# Altium schematic sheet GenPulseBox.SchDoc (part 1 of 2)
size 839 x 594 mm; DecimalNumber: Э-905 Э3; MainDevice: Генератор НЧ импульсов; Name: Генератор НЧ импульсов; PageSetup: Record=PageOptions|CenterHorizontal=True|CenterVertical=True|PrintScale=0.94|XCorrection=1.00|YCorrection=1.00|PrintKind=1|BorderSize=5000000|LeftOffset=0|BottomOffset=0|Orientation=1|PaperLength=1000|PaperWidth=1000|Scale=100|PaperSource=7|PrintQuality=-4|MediaType=1|DitherType=10|PaperKind=A4|PrintScaleMode=1; ApprovedBy: Кайбалдиев; CheckedBy: Савельев; DrawnBy: Соловьев; Engineer: Т.контр.; DocumentNumber: Э-905 Э3; SheetTotal: 1; Title1str: Генератор НЧ импульсов; DocumentType1str: Схема электрическая; DocumentType2str: принципиальная; ImagePath: Э-905
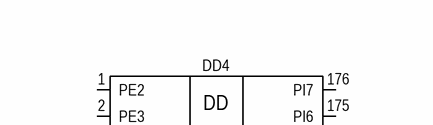
[diagram p0: GenPulseBox.SchDoc, top left]
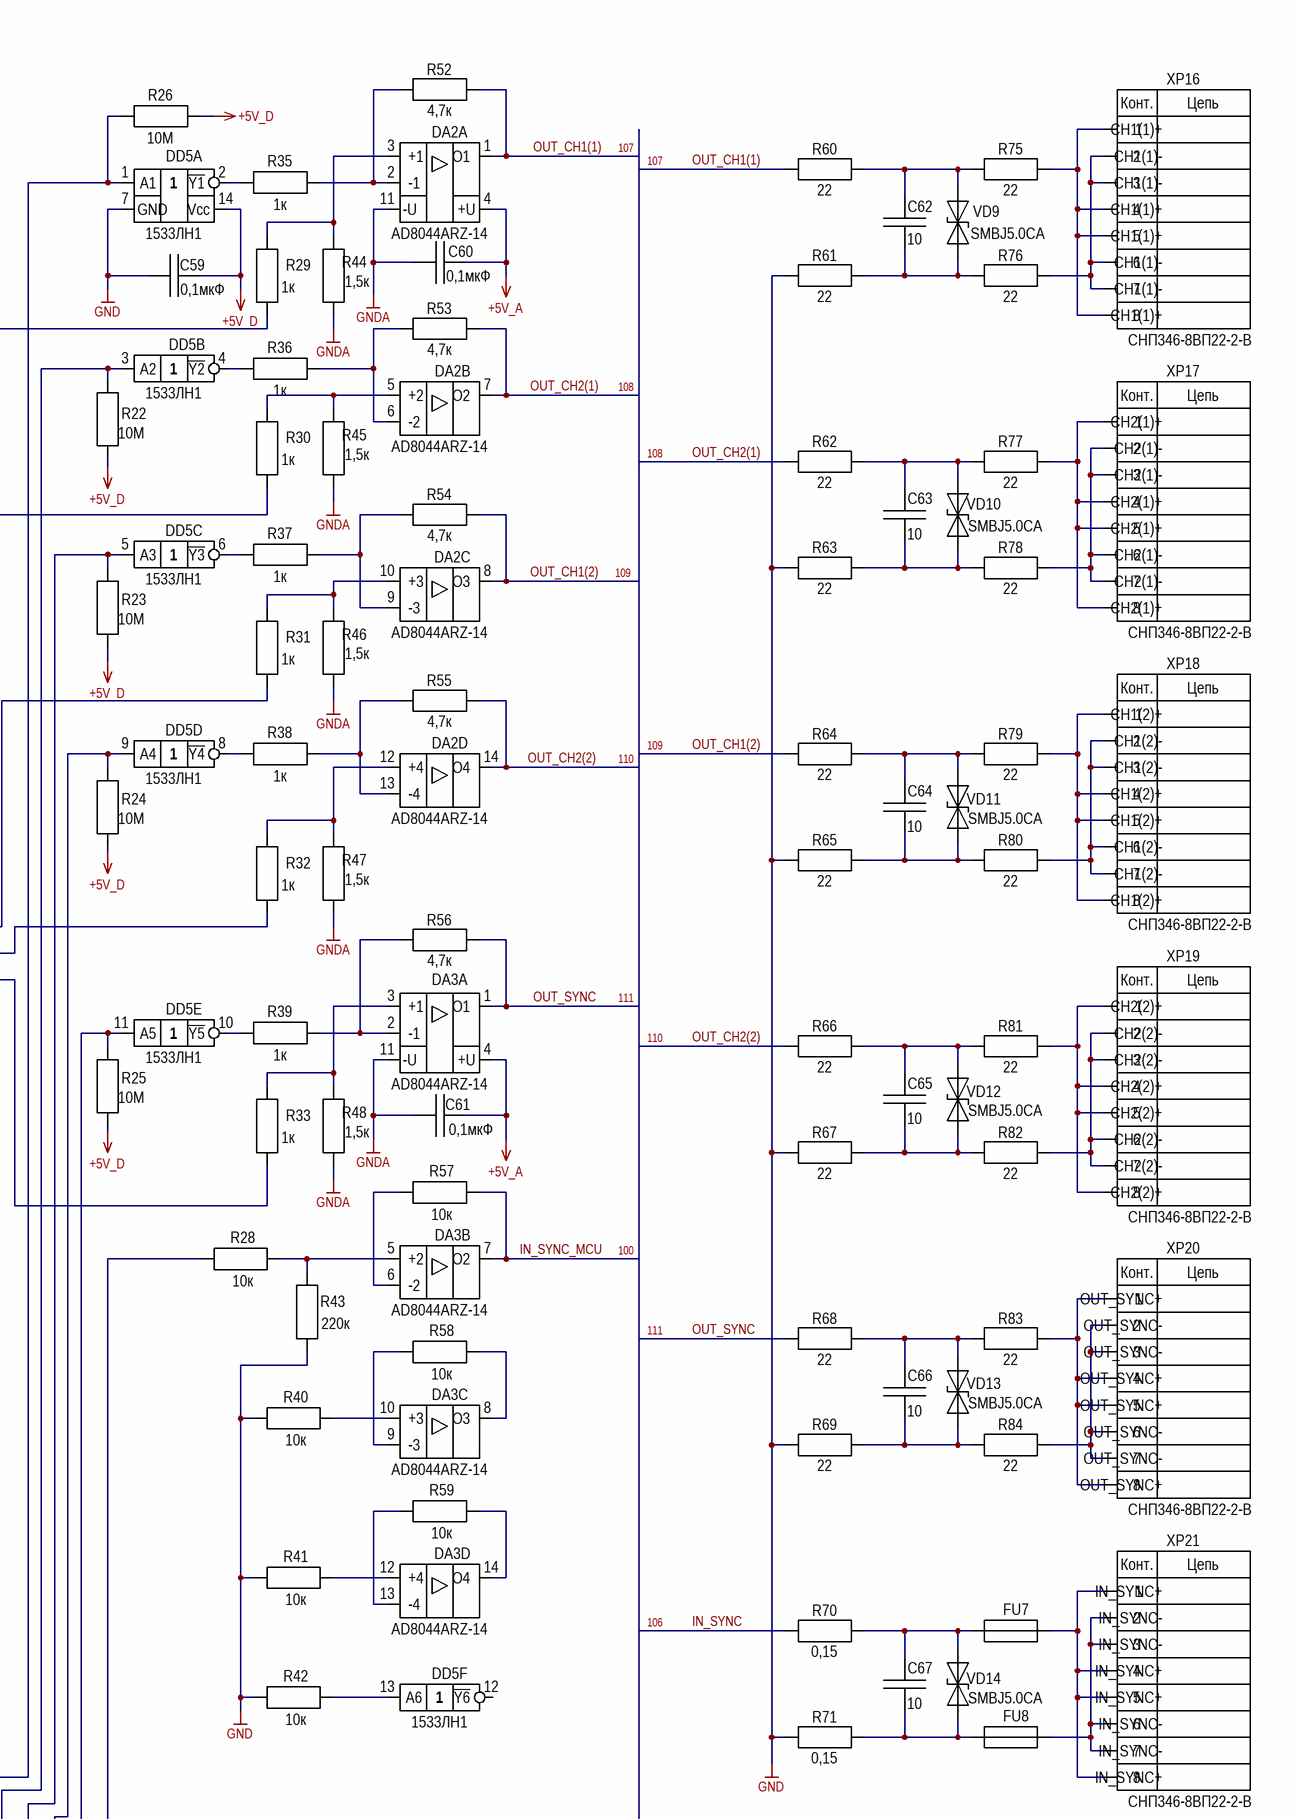
[diagram p1: GenPulseBox.SchDoc, top right]
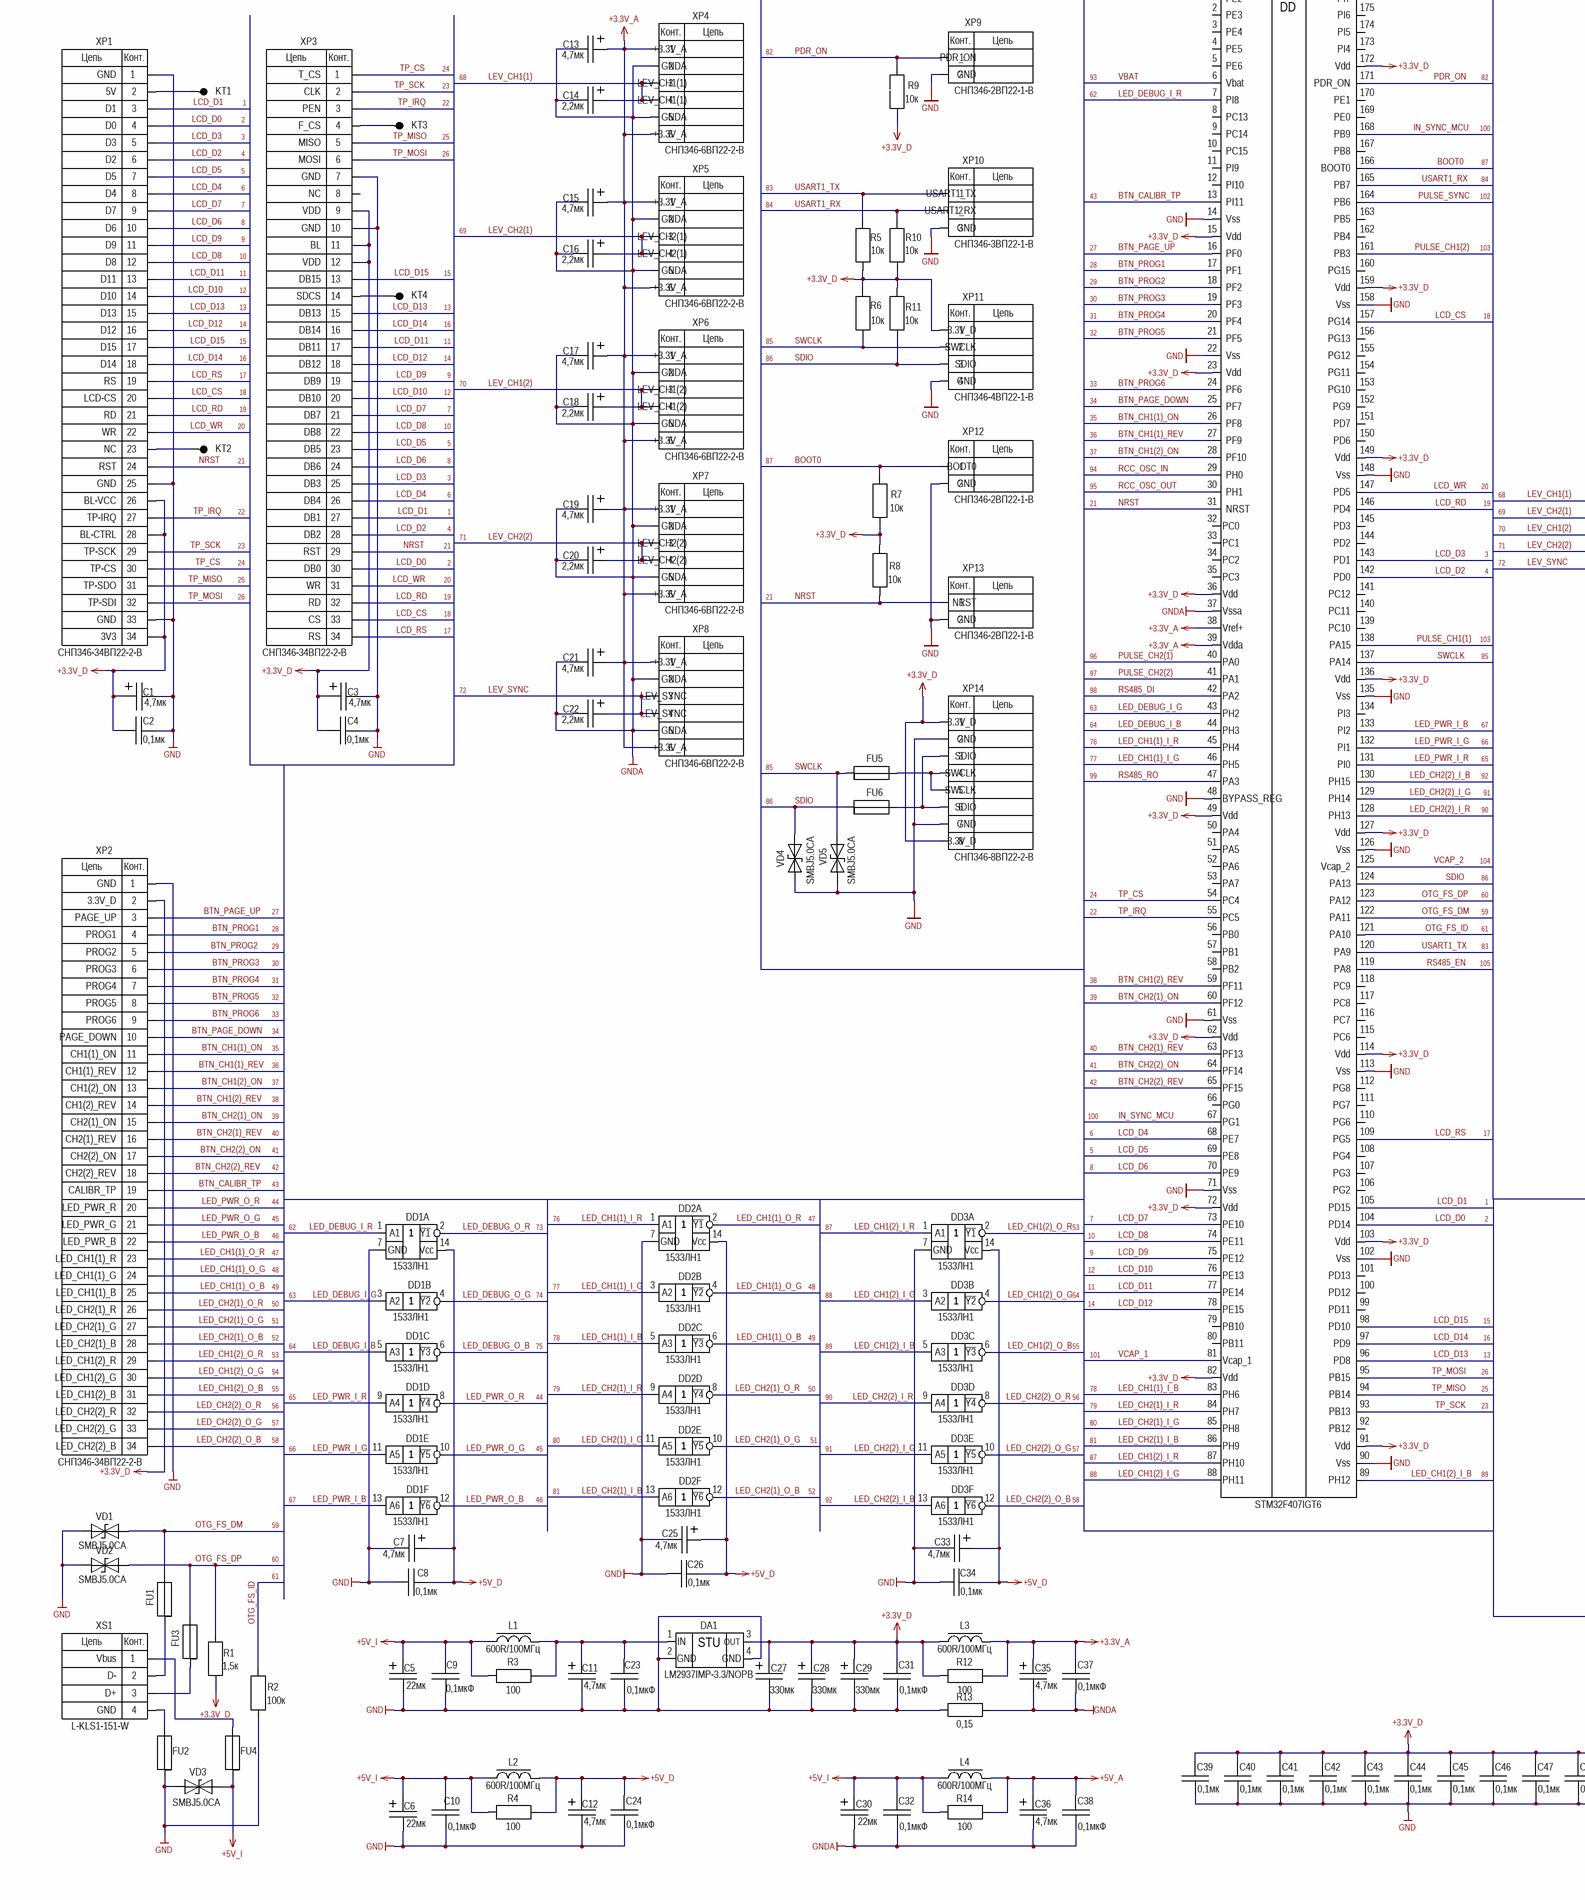
[diagram p2: GenPulseBox.SchDoc, bottom left]
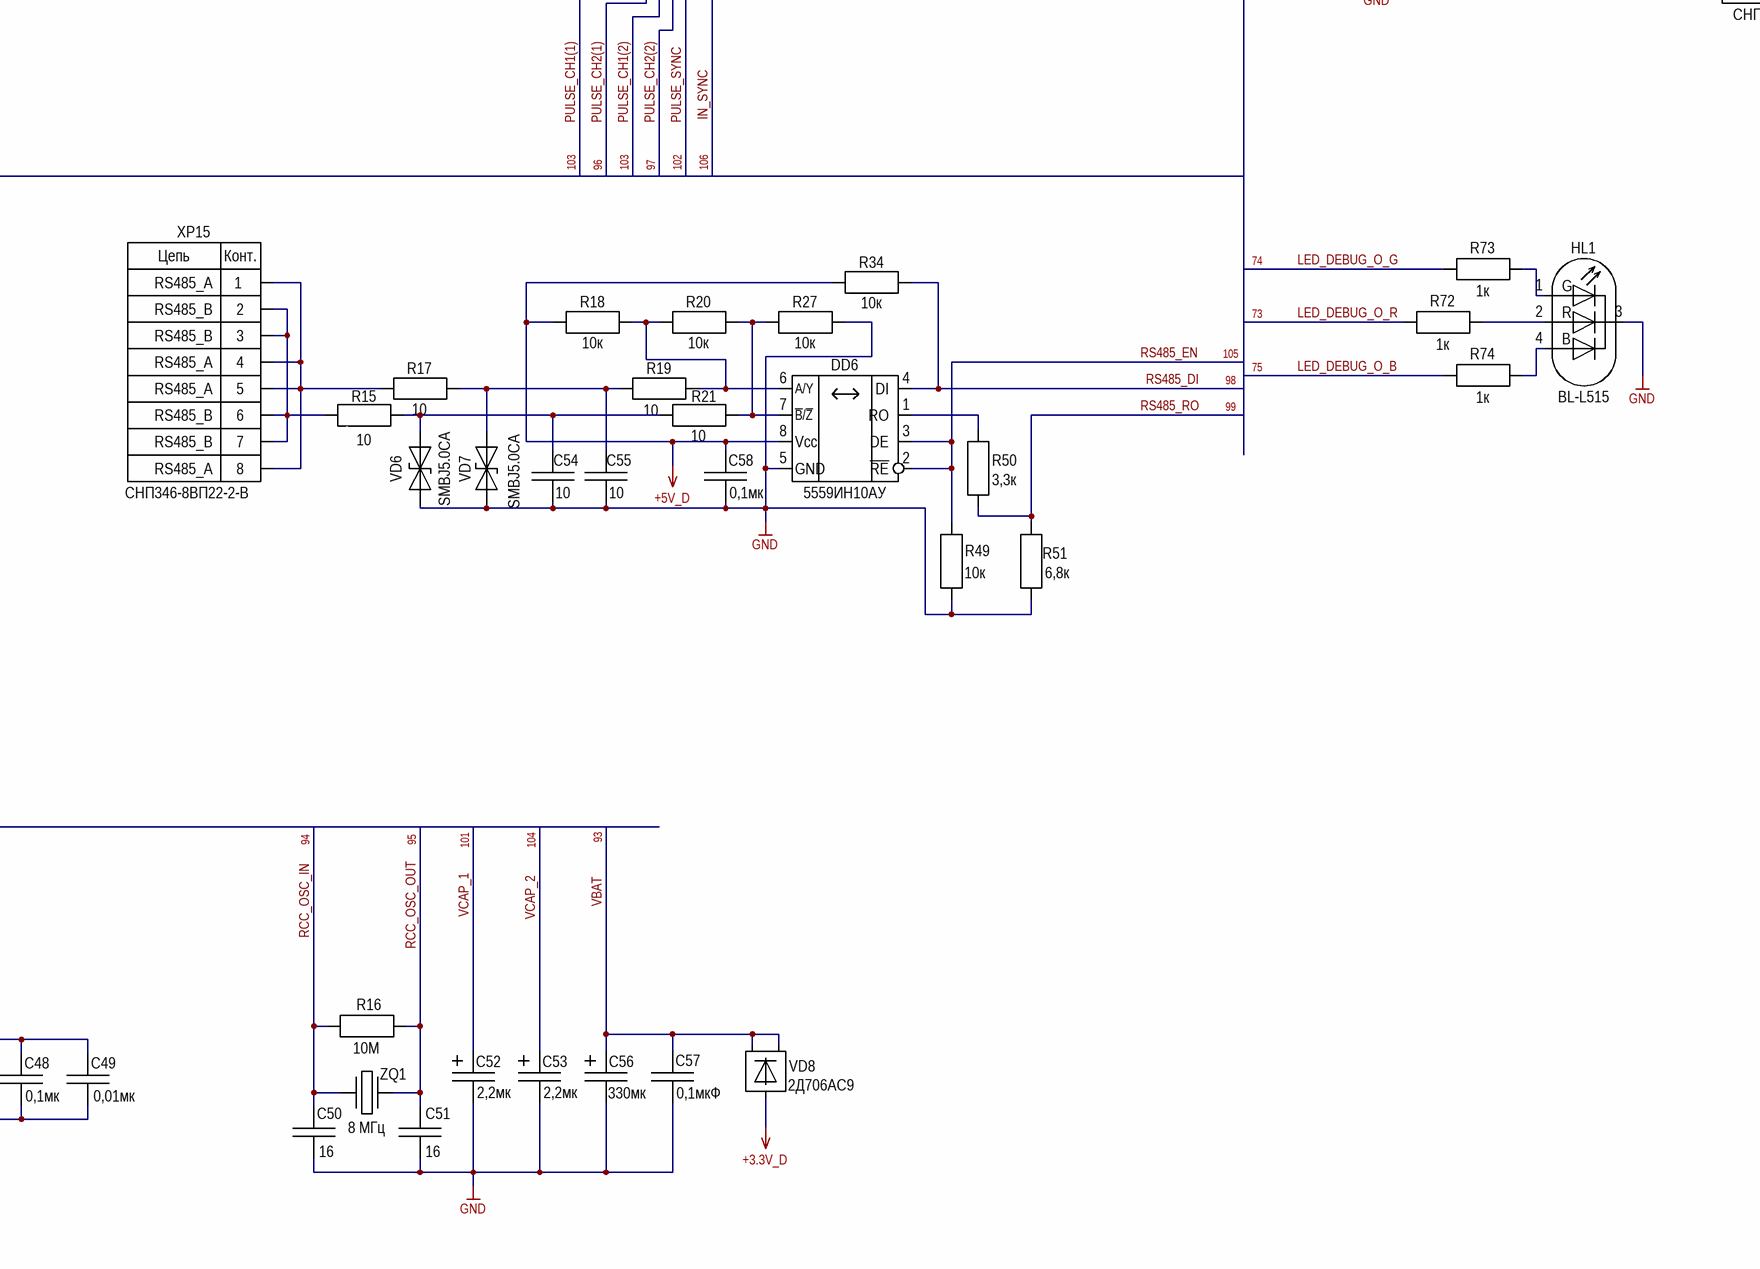
[diagram p3: GenPulseBox.SchDoc, bottom right]

## Parts
C1  value 4,7мк  [CapCaseB]  (hidden comment: PolCap)
C2  value 0,1мк  [Cap0805]  (hidden comment: Capacitor)
C3  value 4,7мк  [CapCaseB]  (hidden comment: PolCap)
C4  value 0,1мк  [Cap0805]  (hidden comment: Capacitor)
C5  value 22мк  [CapCaseC]  (hidden comment: PolCap)
C6  value 22мк  [CapCaseC]  (hidden comment: PolCap)
C7  value 4,7мк  [CapCaseB]  (hidden comment: PolCap)
C8  value 0,1мк  [Cap0805]  (hidden comment: Capacitor)
C9  value 0,1мкФ  [Cap0805]  (hidden comment: Capacitor)
C10  value 0,1мкФ  [Cap0805]  (hidden comment: Capacitor)
C11  value 4,7мк  [CapCaseB]  (hidden comment: PolCap)
C12  value 4,7мк  [CapCaseB]  (hidden comment: PolCap)
C13  value 4,7мк  [CapCaseB]  (hidden comment: PolCap)
C14  value 2,2мк  [CapCaseB]  (hidden comment: PolCap)
C15  value 4,7мк  [CapCaseB]  (hidden comment: PolCap)
C16  value 2,2мк  [CapCaseB]  (hidden comment: PolCap)
C17  value 4,7мк  [CapCaseB]  (hidden comment: PolCap)
C18  value 2,2мк  [CapCaseB]  (hidden comment: PolCap)
C19  value 4,7мк  [CapCaseB]  (hidden comment: PolCap)
C20  value 2,2мк  [CapCaseB]  (hidden comment: PolCap)
C21  value 4,7мк  [CapCaseB]  (hidden comment: PolCap)
C22  value 2,2мк  [CapCaseB]  (hidden comment: PolCap)
C23  value 0,1мкФ  [Cap0805]  (hidden comment: Capacitor)
C24  value 0,1мкФ  [Cap0805]  (hidden comment: Capacitor)
C25  value 4,7мк  [CapCaseB]  (hidden comment: PolCap)
C26  value 0,1мк  [Cap0805]  (hidden comment: Capacitor)
C27  value 330мк  [CapCaseD]  (hidden comment: PolCap)
C28  value 330мк  [CapCaseD]  (hidden comment: PolCap)
C29  value 330мк  [CapCaseD]  (hidden comment: PolCap)
C30  value 22мк  [CapCaseC]  (hidden comment: PolCap)
C31  value 0,1мкФ  [Cap0805]  (hidden comment: Capacitor)
C32  value 0,1мкФ  [Cap0805]  (hidden comment: Capacitor)
C33  value 4,7мк  [CapCaseB]  (hidden comment: PolCap)
C34  value 0,1мк  [Cap0805]  (hidden comment: Capacitor)
C35  value 4,7мк  [CapCaseB]  (hidden comment: PolCap)
C36  value 4,7мк  [CapCaseB]  (hidden comment: PolCap)
C37  value 0,1мкФ  [Cap0805]  (hidden comment: Capacitor)
C38  value 0,1мкФ  [Cap0805]  (hidden comment: Capacitor)
C39  value 0,1мк  [Cap0805]  (hidden comment: Capacitor)
C40  value 0,1мк  [Cap0805]  (hidden comment: Capacitor)
C41  value 0,1мк  [Cap0805]  (hidden comment: Capacitor)
C42  value 0,1мк  [Cap0805]  (hidden comment: Capacitor)
C43  value 0,1мк  [Cap0805]  (hidden comment: Capacitor)
C44  value 0,1мк  [Cap0805]  (hidden comment: Capacitor)
C45  value 0,1мк  [Cap0805]  (hidden comment: Capacitor)
C46  value 0,1мк  [Cap0805]  (hidden comment: Capacitor)
C47  value 0,1мк  [Cap0805]  (hidden comment: Capacitor)
C48  value 0,1мк  [Cap0805]  (hidden comment: Capacitor)
C49  value 0,01мк  [Cap0805]  (hidden comment: Capacitor)
C50  value 16  [Cap0805]  (hidden comment: Capacitor)
C51  value 16  [Cap0805]  (hidden comment: Capacitor)
C52  value 2,2мк  [CapCaseB]  (hidden comment: PolCap)
C53  value 2,2мк  [CapCaseB]  (hidden comment: PolCap)
C54  value 10  [Cap0603]  (hidden comment: Capacitor)
C55  value 10  [Cap0603]  (hidden comment: Capacitor)
C56  value 330мк  [CapCaseD]  (hidden comment: PolCap)
C57  value 0,1мкФ  [Cap0805]  (hidden comment: Capacitor)
C58  value 0,1мк  [Cap0805]  (hidden comment: Capacitor)
C59  value 0,1мкФ  [Cap0805]  (hidden comment: Capacitor)
C60  value 0,1мкФ  [Cap0805]  (hidden comment: Capacitor)
C61  value 0,1мкФ  [Cap0805]  (hidden comment: Capacitor)
C62  value 10  [Cap0603]  (hidden comment: Capacitor)
C63  value 10  [Cap0603]  (hidden comment: Capacitor)
C64  value 10  [Cap0603]  (hidden comment: Capacitor)
C65  value 10  [Cap0603]  (hidden comment: Capacitor)
C66  value 10  [Cap0603]  (hidden comment: Capacitor)
C67  value 10  [Cap0603]  (hidden comment: Capacitor)
DA1  LM2937IMP-3.3  [SOT223]  (value not drawn)
DA2  AD824  [SOIC14]  (value not drawn)  (parts A,B,C,D of 4)
DA3  AD824  [SOIC14]  (value not drawn)  (parts A,B,C,D of 4)
DD1  1533LN1  [401.14-5]  (value not drawn)  (parts A,B,C,D,E,F of 6)
DD2  1533LN1  [401.14-5]  (value not drawn)  (parts A,B,C,D,E,F of 6)
DD3  1533LN1  [401.14-5]  (value not drawn)  (parts A,B,C,D,E,F of 6)
DD4  STM32F407IGT6  [LQFP176]
DD5  1533LN1  [401.14-5]  (value not drawn)  (parts A,B,C,D,E,F of 6)
DD6  5559IN10U  [H02.8-1B_SOIC8]  (value not drawn)
FU1  Predoxranitel  [MF-R50]  (value not drawn)
FU2  Predoxranitel  [MF-R185]  (value not drawn)
FU3  Predoxranitel  [MF-R50]  (value not drawn)
FU4  Predoxranitel  [MF-R185]  (value not drawn)
FU5  Predoxranitel  [MF-R50]  (value not drawn)
FU6  Predoxranitel  [MF-R50]  (value not drawn)
FU7  Predoxranitel  [MF-R50]  (value not drawn)
FU8  Predoxranitel  [MF-R50]  (value not drawn)
HL1  LED-RGB_C  [BL-L515]  (value not drawn)
KT1  Kont  [TESTPOINT]  (value not drawn)  (no BOM)
KT2  Kont  [TESTPOINT]  (value not drawn)  (no BOM)
KT3  Kont  [TESTPOINT]  (value not drawn)  (no BOM)
KT4  Kont  [TESTPOINT]  (value not drawn)  (no BOM)
L1  value 600R/100MГц  [Ind1206]  (hidden comment: Ferrit)
L2  value 600R/100MГц  [Ind1206]  (hidden comment: Ferrit)
L3  value 600R/100MГц  [Ind1206]  (hidden comment: Ferrit)
L4  value 600R/100MГц  [Ind1206]  (hidden comment: Ferrit)
R1  value 1,5к  [Res0805]  (hidden comment: Resistor0125)
R2  value 100к  [Res0805]  (hidden comment: Resistor0125)
R3  value 100  [Res1206]  (hidden comment: Resistor025)
R4  value 100  [Res1206]  (hidden comment: Resistor025)
R5  value 10к  [Res0402]  (hidden comment: Resistor0062)
R6  value 10к  [Res0402]  (hidden comment: Resistor0062)
R7  value 10к  [Res0402]  (hidden comment: Resistor0062)
R8  value 10к  [Res0402]  (hidden comment: Resistor0062)
R9  value 10к  [Res0402]  (hidden comment: Resistor0062)
R10  value 10к  [Res0402]  (hidden comment: Resistor0062)
R11  value 10к  [Res0402]  (hidden comment: Resistor0062)
R12  value 100  [Res1206]  (hidden comment: Resistor025)
R13  value 0,15  [Res2512]  (hidden comment: Resistor1)
R14  value 100  [Res1206]  (hidden comment: Resistor025)
R15  value 10  [Res0603]  (hidden comment: Resistor01)
R16  value 10М  [Res0805]  (hidden comment: Resistor0125)
R17  value 10  [Res0603]  (hidden comment: Resistor01)
R18  value 10к  [Res0603]  (hidden comment: Resistor01)
R19  value 10  [Res0603]  (hidden comment: Resistor01)
R20  value 10к  [Res0603]  (hidden comment: Resistor01)
R21  value 10  [Res0603]  (hidden comment: Resistor01)
R22  value 10М  [Res0805]  (hidden comment: Resistor0125)
R23  value 10М  [Res0805]  (hidden comment: Resistor0125)
R24  value 10М  [Res0805]  (hidden comment: Resistor0125)
R25  value 10М  [Res0805]  (hidden comment: Resistor0125)
R26  value 10М  [Res0805]  (hidden comment: Resistor0125)
R27  value 10к  [Res0603]  (hidden comment: Resistor01)
R28  value 10к  [Res0603]  (hidden comment: Resistor01)
R29  value 1к  [Res0805]  (hidden comment: Resistor0125)
R30  value 1к  [Res0805]  (hidden comment: Resistor0125)
R31  value 1к  [Res0805]  (hidden comment: Resistor0125)
R32  value 1к  [Res0805]  (hidden comment: Resistor0125)
R33  value 1к  [Res0805]  (hidden comment: Resistor0125)
R34  value 10к  [Res0603]  (hidden comment: Resistor01)
R35  value 1к  [Res0805]  (hidden comment: Resistor0125)
R36  value 1к  [Res0805]  (hidden comment: Resistor0125)
R37  value 1к  [Res0805]  (hidden comment: Resistor0125)
R38  value 1к  [Res0805]  (hidden comment: Resistor0125)
R39  value 1к  [Res0805]  (hidden comment: Resistor0125)
R40  value 10к  [Res0603]  (hidden comment: Resistor01)
R41  value 10к  [Res0603]  (hidden comment: Resistor01)
R42  value 10к  [Res0603]  (hidden comment: Resistor01)
R43  value 220к  [Res0805]  (hidden comment: Resistor0125)
R44  value 1,5к  [Res0603]  (hidden comment: Resistor01)
R45  value 1,5к  [Res0603]  (hidden comment: Resistor01)
R46  value 1,5к  [Res0603]  (hidden comment: Resistor01)
R47  value 1,5к  [Res0603]  (hidden comment: Resistor01)
R48  value 1,5к  [Res0603]  (hidden comment: Resistor01)
R49  value 10к  [Res0603]  (hidden comment: Resistor01)
R50  value 3,3к  [Res0603]  (hidden comment: Resistor01)
R51  value 6,8к  [Res0603]  (hidden comment: Resistor01)
R52  value 4,7к  [Res0603]  (hidden comment: Resistor01)
R53  value 4,7к  [Res0603]  (hidden comment: Resistor01)
R54  value 4,7к  [Res0603]  (hidden comment: Resistor01)
R55  value 4,7к  [Res0603]  (hidden comment: Resistor01)
R56  value 4,7к  [Res0603]  (hidden comment: Resistor01)
R57  value 10к  [Res0603]  (hidden comment: Resistor01)
R58  value 10к  [Res0603]  (hidden comment: Resistor01)
R59  value 10к  [Res0603]  (hidden comment: Resistor01)
R60  value 22  [Res2512]  (hidden comment: Resistor1)
R61  value 22  [Res2512]  (hidden comment: Resistor1)
R62  value 22  [Res2512]  (hidden comment: Resistor1)
R63  value 22  [Res2512]  (hidden comment: Resistor1)
R64  value 22  [Res2512]  (hidden comment: Resistor1)
R65  value 22  [Res2512]  (hidden comment: Resistor1)
R66  value 22  [Res2512]  (hidden comment: Resistor1)
R67  value 22  [Res2512]  (hidden comment: Resistor1)
R68  value 22  [Res2512]  (hidden comment: Resistor1)
R69  value 22  [Res2512]  (hidden comment: Resistor1)
R70  value 0,15  [Res2512]  (hidden comment: Resistor1)
R71  value 0,15  [Res2512]  (hidden comment: Resistor1)
R72  value 1к  [Res0805]  (hidden comment: Resistor0125)
R73  value 1к  [Res0805]  (hidden comment: Resistor0125)
R74  value 1к  [Res0805]  (hidden comment: Resistor0125)
R75  value 22  [Res2512]  (hidden comment: Resistor1)
R76  value 22  [Res2512]  (hidden comment: Resistor1)
R77  value 22  [Res2512]  (hidden comment: Resistor1)
R78  value 22  [Res2512]  (hidden comment: Resistor1)
R79  value 22  [Res2512]  (hidden comment: Resistor1)
R80  value 22  [Res2512]  (hidden comment: Resistor1)
R81  value 22  [Res2512]  (hidden comment: Resistor1)
R82  value 22  [Res2512]  (hidden comment: Resistor1)
R83  value 22  [Res2512]  (hidden comment: Resistor1)
R84  value 22  [Res2512]  (hidden comment: Resistor1)
VD1  Name: SMBJ5.0CA  [SMB_(DO-214AA) KA1-KA2]  (hidden comment: DiodZachitnuy)
VD2  Name: SMBJ5.0CA  [SMB_(DO-214AA) KA1-KA2]  (hidden comment: DiodZachitnuy)
VD3  Name: SMBJ5.0CA  [SMB_(DO-214AA) KA1-KA2]  (hidden comment: DiodZachitnuy)
VD4  Name: SMBJ5.0CA  [SMB_(DO-214AA) KA1-KA2]  (hidden comment: DiodZachitnuy)
VD5  Name: SMBJ5.0CA  [SMB_(DO-214AA) KA1-KA2]  (hidden comment: DiodZachitnuy)
VD6  Name: SMBJ5.0CA  [SMB_(DO-214AA) KA1-KA2]  (hidden comment: DiodZachitnuy)
VD7  Name: SMBJ5.0CA  [SMB_(DO-214AA) KA1-KA2]  (hidden comment: DiodZachitnuy)
VD8  Name: 2Д706АС9  [SOT23 2D706AS9]  (hidden comment: Diod2K)
VD9  Name: SMBJ5.0CA  [SMB_(DO-214AA) KA1-KA2]  (hidden comment: DiodZachitnuy)
VD10  Name: SMBJ5.0CA  [SMB_(DO-214AA) KA1-KA2]  (hidden comment: DiodZachitnuy)
VD11  Name: SMBJ5.0CA  [SMB_(DO-214AA) KA1-KA2]  (hidden comment: DiodZachitnuy)
VD12  Name: SMBJ5.0CA  [SMB_(DO-214AA) KA1-KA2]  (hidden comment: DiodZachitnuy)
VD13  Name: SMBJ5.0CA  [SMB_(DO-214AA) KA1-KA2]  (hidden comment: DiodZachitnuy)
VD14  Name: SMBJ5.0CA  [SMB_(DO-214AA) KA1-KA2]  (hidden comment: DiodZachitnuy)
XP1  ConnectorP34  [PLD-34]  (value not drawn)
XP2  ConnectorP34  [PLD-34]  (value not drawn)
XP3  ConnectorP34  [PLD-34]  (value not drawn)
XP4  ConnectorP6  [PLD-6]  (value not drawn)
XP5  ConnectorP6  [PLD-6]  (value not drawn)
XP6  ConnectorP6  [PLD-6]  (value not drawn)
XP7  ConnectorP6  [PLD-6]  (value not drawn)
XP8  ConnectorP6  [PLD-6]  (value not drawn)
XP9  ConnectorP2  [PLS-2]  (value not drawn)
XP10  ConnectorP3  [PLS-3]  (value not drawn)
XP11  ConnectorP4  [PLS-4]  (value not drawn)
XP12  ConnectorP2  [PLS-2]  (value not drawn)
XP13  ConnectorP2  [PLS-2]  (value not drawn)
XP14  ConnectorP8  [PLD-8]  (value not drawn)
XP15  ConnectorP8  [PLD-8]  (value not drawn)
XP16  ConnectorP8  [PLD-8]  (value not drawn)
XP17  ConnectorP8  [PLD-8]  (value not drawn)
XP18  ConnectorP8  [PLD-8]  (value not drawn)
XP19  ConnectorP8  [PLD-8]  (value not drawn)
XP20  ConnectorP8  [PLD-8]  (value not drawn)
XP21  ConnectorP8  [PLD-8]  (value not drawn)
XS1  ConnectorS4_USB_B  [USB_B]  (value not drawn)
ZQ1  value 8 МГц  [HC-49SM_U]  (hidden comment: Quartz)

## Nets
+3.3V_A: C13.2 C15.2 C17.2 C19.2 C21.2 C35.2 C37.2 DD4.38(Vref+) DD4.39(Vdda) L3.2 R12.2 XP4.1 XP4.6 XP5.1 XP5.6 XP6.1 XP6.6 XP7.1 XP7.6 XP8.1 XP8.6
+3.3V_D: C1.2 C2.2 C3.2 C4.2 C27.2 C28.2 C29.2 C31.2 C39.2 C40.2 C41.2 C42.2 C43.2 C44.2 C45.2 C46.2 C47.2 C48.2 C49.2 DA1.3(OUT) DD4.15(Vdd) DD4.23(Vdd) DD4.36(Vdd) DD4.49(Vdd) DD4.62(Vdd) DD4.72(Vdd) DD4.82(Vdd) DD4.91(Vdd) DD4.103(Vdd) DD4.114(Vdd) DD4.127(Vdd) DD4.136(Vdd) DD4.149(Vdd) DD4.159(Vdd) DD4.172(Vdd) L3.1 R1.1 R5.2 R6.2 R7.2 R8.1 R9.1 R10.2 R11.2 R12.1 VD8.A XP1.26 XP1.28 XP1.34 XP2.2 XP3.9 XP3.11 XP3.12 XP11.1 XP14.1 XP14.8
+5V_A: C36.2 C38.2 C60.2 C61.2 DA2.4(+U) DA3.4(+U) L4.2 R14.2
+5V_D: C7.2 C8.1 C12.2 C24.2 C25.2 C26.1 C33.2 C34.1 C58.2 C59.2 DD1.14(Vcc) DD2.14(Vcc) DD3.14(Vcc) DD5.14(Vcc) DD6.8(Vcc) L2.2 R4.2 R18.1 R22.2 R23.2 R24.2 R25.2 R26.2 R34.1
+5V_I: C5.2 C6.2 C9.2 C10.2 C30.2 C32.2 FU4.1 L1.1 L2.1 L4.1 R3.1 R4.1 R14.1 VD3.KA2
GND: C1.1 C2.1 C3.1 C4.1 C5.1 C6.1 C7.1 C8.2 C9.1 C10.1 C11.1 C12.1 C23.1 C24.1 C25.1 C26.2 C27.1 C28.1 C29.1 C31.1 C33.1 C34.2 C39.1 C40.1 C41.1 C42.1 C43.1 C44.1 C45.1 C46.1 C47.1 C48.1 C49.1 C50.1 C51.1 C52.1 C53.1 C54.1 C55.1 C56.1 C57.1 C58.1 C59.1 DA1.2(GND) DA1.4(GND) DD1.7(GND) DD2.7(GND) DD3.7(GND) DD4.14(Vss) DD4.22(Vss) DD4.48(BYPASS_REG) DD4.61(Vss) DD4.71(Vss) DD4.90(Vss) DD4.102(Vss) DD4.113(Vss) DD4.126(Vss) DD4.135(Vss) DD4.148(Vss) DD4.158(Vss) DD5.7(GND) DD6.5(GND) FU2.1 HL1.3(A) R2.1 R13.1 R27.2 R40.2 R41.2 R42.2 R43.1 R49.1 R51.1 R61.1 R63.1 R65.1 R67.1 R69.1 R71.1 VD1.KA1 VD2.KA1 VD3.KA1 VD4.KA1 VD5.KA1 VD6.KA1 VD7.KA1 XP1.1 XP1.25 XP1.33 XP2.1 XP3.7 XP3.10 XP9.2 XP10.3 XP11.4 XP12.2 XP13.2 XP14.2 XP14.7
GNDA: C13.1 C14.1 C15.1 C16.1 C17.1 C18.1 C19.1 C20.1 C21.1 C22.1 C30.1 C32.1 C35.1 C36.1 C37.1 C38.1 C60.1 C61.1 DA2.11(-U) DA3.11(-U) DD4.37(Vssa) R13.2 R44.1 R45.1 R46.1 R47.1 R48.1 XP4.2 XP4.5 XP5.2 XP5.5 XP6.2 XP6.5 XP7.2 XP7.5 XP8.2 XP8.5
BOOT0: DD4.166(BOOT0) R7.1 XP12.1
BTN_CALIBR_TP: DD4.13(PI11) XP2.19
BTN_CH1(1)_ON: DD4.26(PF8) XP2.11
BTN_CH1(1)_REV: DD4.27(PF9) XP2.12
BTN_CH1(2)_ON: DD4.28(PF10) XP2.13
BTN_CH1(2)_REV: DD4.59(PF11) XP2.14
BTN_CH2(1)_ON: DD4.60(PF12) XP2.15
BTN_CH2(1)_REV: DD4.63(PF13) XP2.16
BTN_CH2(2)_ON: DD4.64(PF14) XP2.17
BTN_CH2(2)_REV: DD4.65(PF15) XP2.18
BTN_PAGE_DOWN: DD4.25(PF7) XP2.10
BTN_PAGE_UP: DD4.16(PF0) XP2.3
BTN_PROG1: DD4.17(PF1) XP2.4
BTN_PROG2: DD4.18(PF2) XP2.5
BTN_PROG3: DD4.19(PF3) XP2.6
BTN_PROG4: DD4.20(PF4) XP2.7
BTN_PROG5: DD4.21(PF5) XP2.8
BTN_PROG6: DD4.24(PF6) XP2.9
IN_SYNC: R28.2 R70.1
IN_SYNC_MCU: DA3.7(O2) DD4.67(PG1) DD4.168(PB9) R57.1
LCD_CS: DD4.157(PG14) XP1.20 XP3.33
LCD_D0: DD4.104(PD14) XP1.4 XP3.30
LCD_D1: DD4.105(PD15) XP1.3 XP3.27
LCD_D2: DD4.142(PD0) XP1.6 XP3.28
LCD_D3: DD4.143(PD1) XP1.5 XP3.25
LCD_D4: DD4.68(PE7) XP1.8 XP3.26
LCD_D5: DD4.69(PE8) XP1.7 XP3.23
LCD_D6: DD4.70(PE9) XP1.10 XP3.24
LCD_D7: DD4.73(PE10) XP1.9 XP3.21
LCD_D8: DD4.74(PE11) XP1.12 XP3.22
LCD_D9: DD4.75(PE12) XP1.11 XP3.19
LCD_D10: DD4.76(PE13) XP1.14 XP3.20
LCD_D11: DD4.77(PE14) XP1.13 XP3.17
LCD_D12: DD4.78(PE15) XP1.16 XP3.18
LCD_D13: DD4.96(PD8) XP1.15 XP3.15
LCD_D14: DD4.97(PD9) XP1.18 XP3.16
LCD_D15: DD4.98(PD10) XP1.17 XP3.13
LCD_RD: DD4.146(PD4) XP1.21 XP3.32
LCD_RS: DD4.109(PG5) XP1.19 XP3.34
LCD_WR: DD4.147(PD5) XP1.22 XP3.31
LED_CH1(1)_I_B: DD2.5(A3) DD4.83(PH6)
LED_CH1(1)_I_G: DD2.3(A2) DD4.46(PH5)
LED_CH1(1)_I_R: DD2.1(A1) DD4.45(PH4)
LED_CH1(1)_O_B: DD2.6(~{Y3}) XP2.25
LED_CH1(1)_O_G: DD2.4(~{Y2}) XP2.24
LED_CH1(1)_O_R: DD2.2(~{Y1}) XP2.23
LED_CH1(2)_I_B: DD3.5(A3) DD4.89(PH12)
LED_CH1(2)_I_G: DD3.3(A2) DD4.88(PH11)
LED_CH1(2)_I_R: DD3.1(A1) DD4.87(PH10)
LED_CH1(2)_O_B: DD3.6(~{Y3}) XP2.31
LED_CH1(2)_O_G: DD3.4(~{Y2}) XP2.30
LED_CH1(2)_O_R: DD3.2(~{Y1}) XP2.29
LED_CH2(1)_I_B: DD2.13(A6) DD4.86(PH9)
LED_CH2(1)_I_G: DD2.11(A5) DD4.85(PH8)
LED_CH2(1)_I_R: DD2.9(A4) DD4.84(PH7)
LED_CH2(1)_O_B: DD2.12(~{Y6}) XP2.28
LED_CH2(1)_O_G: DD2.10(~{Y5}) XP2.27
LED_CH2(1)_O_R: DD2.8(~{Y4}) XP2.26
LED_CH2(2)_I_B: DD3.13(A6) DD4.130(PH15)
LED_CH2(2)_I_G: DD3.11(A5) DD4.129(PH14)
LED_CH2(2)_I_R: DD3.9(A4) DD4.128(PH13)
LED_CH2(2)_O_B: DD3.12(~{Y6}) XP2.34
LED_CH2(2)_O_G: DD3.10(~{Y5}) XP2.33
LED_CH2(2)_O_R: DD3.8(~{Y4}) XP2.32
LED_DEBUG_I_B: DD1.5(A3) DD4.44(PH3)
LED_DEBUG_I_G: DD1.3(A2) DD4.43(PH2)
LED_DEBUG_I_R: DD1.1(A1) DD4.7(PI8)
LED_DEBUG_O_B: DD1.6(~{Y3}) R74.2
LED_DEBUG_O_G: DD1.4(~{Y2}) R73.2
LED_DEBUG_O_R: DD1.2(~{Y1}) R72.2
LED_PWR_I_B: DD1.13(A6) DD4.133(PI2)
LED_PWR_I_G: DD1.11(A5) DD4.132(PI1)
LED_PWR_I_R: DD1.9(A4) DD4.131(PI0)
LED_PWR_O_B: DD1.12(~{Y6}) XP2.22
LED_PWR_O_G: DD1.10(~{Y5}) XP2.21
LED_PWR_O_R: DD1.8(~{Y4}) XP2.20
LEV_CH1(1): C14.2 R29.2 XP4.3 XP4.4
LEV_CH1(2): C18.2 R31.2 XP6.3 XP6.4
LEV_CH2(1): C16.2 R30.2 XP5.3 XP5.4
LEV_CH2(2): C20.2 R32.2 XP7.3 XP7.4
LEV_SYNC: C22.2 R33.2 XP8.3 XP8.4
NRST: DD4.31(NRST) R8.2 XP1.24 XP3.29 XP13.1
OTG_FS_DM: DD4.122(PA11) FU1.2 VD1.KA2
OTG_FS_DP: DD4.123(PA12) FU3.2 R1.2 VD2.KA2
OTG_FS_ID: DD4.121(PA10) R2.2
OUT_CH1(1): DA2.1(O1) R52.2 R60.1
OUT_CH1(2): DA2.8(O3) R54.2 R64.1
OUT_CH2(1): DA2.7(O2) R53.2 R62.1
OUT_CH2(2): DA2.14(O4) R55.2 R66.1
OUT_SYNC: DA3.1(O1) R56.2 R68.1
PDR_ON: DD4.171(PDR_ON) R9.2 XP9.1
PULSE_CH1(1): DD4.138(PA15) DD5.1(A1) R26.1
PULSE_CH1(2): DD4.161(PB3) DD5.5(A3) R23.1
PULSE_CH2(1): DD4.40(PA0) DD5.3(A2) R22.1
PULSE_CH2(2): DD4.41(PA1) DD5.9(A4) R24.1
PULSE_SYNC: DD4.164(PB6) DD5.11(A5) R25.1
RCC_OSC_IN: C50.2 DD4.29(PH0) R16.2 ZQ1.2
RCC_OSC_OUT: C51.2 DD4.30(PH1) R16.1 ZQ1.1
RS485_DI: DD4.42(PA2) DD6.4(DI) R34.2
RS485_EN: DD4.119(PA8) DD6.2(~{RE}) DD6.3(DE) R49.2
RS485_RO: DD4.47(PA3) R50.1 R51.2
SDIO: DD4.124(PA13) FU6.1 R11.1 VD4.KA2 XP11.3
SWCLK: DD4.137(PA14) FU5.1 R6.1 VD5.KA2 XP11.2
TP_CS: DD4.54(PC4) XP1.30 XP3.1
TP_IRQ: DD4.55(PC5) XP1.27 XP3.3
TP_MISO: DD4.94(PB14) XP1.31 XP3.5
TP_MOSI: DD4.95(PB15) XP1.32 XP3.6
TP_SCK: DD4.93(PB13) XP1.29 XP3.2
USART1_RX: DD4.165(PB7) R10.1 XP10.2
USART1_TX: DD4.120(PA9) R5.1 XP10.1
VBAT: C56.2 C57.2 DD4.6(Vbat) VD8.K1 VD8.K2
VCAP_1: C52.2 DD4.81(Vcap_1)
VCAP_2: C53.2 DD4.125(Vcap_2)
NetC11_2: C11.2 C23.2 DA1.1(IN) L1.2 R3.2
NetC54_2: C54.2 R15.2 R21.1 VD6.KA2
NetC55_2: C55.2 R17.2 R19.1 VD7.KA2
NetC62_1: C62.1 R61.2 R76.1 VD9.KA1
NetC62_2: C62.2 R60.2 R75.1 VD9.KA2
NetC63_1: C63.1 R63.2 R78.1 VD10.KA1
NetC63_2: C63.2 R62.2 R77.1 VD10.KA2
NetC64_1: C64.1 R65.2 R80.1 VD11.KA1
NetC64_2: C64.2 R64.2 R79.1 VD11.KA2
NetC65_1: C65.1 R67.2 R82.1 VD12.KA1
NetC65_2: C65.2 R66.2 R81.1 VD12.KA2
NetC66_1: C66.1 R69.2 R84.1 VD13.KA1
NetC66_2: C66.2 R68.2 R83.1 VD13.KA2
NetC67_1: C67.1 FU8.1 R71.2 VD14.KA1
NetC67_2: C67.2 FU7.1 R70.2 VD14.KA2
NetDA2_2: DA2.2(-1) R35.1 R52.1
NetDA2_3: DA2.3(+1) R29.1 R44.2
NetDA2_5: DA2.5(+2) R30.1 R45.2
NetDA2_6: DA2.6(-2) R36.1 R53.1
NetDA2_9: DA2.9(-3) R37.1 R54.1
NetDA2_10: DA2.10(+3) R31.1 R46.2
NetDA2_12: DA2.12(+4) R32.1 R47.2
NetDA2_13: DA2.13(-4) R38.1 R55.1
NetDA3_2: DA3.2(-1) R39.1 R56.1
NetDA3_3: DA3.3(+1) R33.1 R48.2
NetDA3_5: DA3.5(+2) R28.1 R43.2
NetDA3_6: DA3.6(-2) R57.2
NetDA3_8: DA3.8(O3) R58.1
NetDA3_9: DA3.9(-3) R58.2
NetDA3_10: DA3.10(+3) R40.1
NetDA3_12: DA3.12(+4) R41.1
NetDA3_13: DA3.13(-4) R59.2
NetDA3_14: DA3.14(O4) R59.1
NetDD5_2: DD5.2(~{Y1}) R35.2
NetDD5_4: DD5.4(~{Y2}) R36.2
NetDD5_6: DD5.6(~{Y3}) R37.2
NetDD5_8: DD5.8(~{Y4}) R38.2
NetDD5_10: DD5.10(~{Y5}) R39.2
NetDD5_13: DD5.13(A6) R42.1
NetDD6_1: DD6.1(RO) R50.2
NetDD6_6: DD6.6(A/Y) R18.2 R19.2 R20.1
NetDD6_7: DD6.7(~{B}/~{Z}) R20.2 R21.2 R27.1
NetFU1_1: FU1.1 XS1.2
NetFU2_2: FU2.2 XS1.4
NetFU3_1: FU3.1 XS1.3
NetFU4_2: FU4.2 XS1.1
NetFU5_2: FU5.2 XP14.4 XP14.5
NetFU6_2: FU6.2 XP14.3 XP14.6
NetFU7_2: FU7.2 XP21.1 XP21.4 XP21.5 XP21.8
NetFU8_2: FU8.2 XP21.2 XP21.3 XP21.6 XP21.7
NetHL1_1: HL1.1(G) R73.1
NetHL1_2: HL1.2(B) R72.1
NetHL1_4: HL1.4(R) R74.1
NetKT1_1: KT1.1 XP1.2
NetKT2_1: KT2.1 XP1.23
NetKT3_1: KT3.1 XP3.4
NetKT4_1: KT4.1 XP3.14
NetR15_1: R15.1 XP15.2 XP15.3 XP15.6 XP15.7
NetR17_1: R17.1 XP15.1 XP15.4 XP15.5 XP15.8
NetR75_2: R75.2 XP16.1 XP16.4 XP16.5 XP16.8
NetR76_2: R76.2 XP16.2 XP16.3 XP16.6 XP16.7
NetR77_2: R77.2 XP17.1 XP17.4 XP17.5 XP17.8
NetR78_2: R78.2 XP17.2 XP17.3 XP17.6 XP17.7
NetR79_2: R79.2 XP18.1 XP18.4 XP18.5 XP18.8
NetR80_2: R80.2 XP18.2 XP18.3 XP18.6 XP18.7
NetR81_2: R81.2 XP19.1 XP19.4 XP19.5 XP19.8
NetR82_2: R82.2 XP19.2 XP19.3 XP19.6 XP19.7
NetR83_2: R83.2 XP20.1 XP20.4 XP20.5 XP20.8
NetR84_2: R84.2 XP20.2 XP20.3 XP20.6 XP20.7

Not connected (* = marked no-connect by the designer): DD4 1(PE2) 2(PE3) 3(PE4) 4(PE5) 5(PE6) 8(PC13) 9(PC14) 10(PC15) 11(PI9) 12(PI10) 32(PC0) 33(PC1) 34(PC2) 35(PC3) 50(PA4) 51(PA5) 52(PA6) 53(PA7) 56(PB0) 57(PB1) 58(PB2) 66(PG0) 79(PB10) 80(PB11) 92(PB12) 99(PD11) 100(PD12) 101(PD13) 106(PG2) 107(PG3) 108(PG4) 110(PG6) 111(PG7) 112(PG8) 115(PС6) 116(PС7) 117(PС8) 118(PС9) 134(PI3) 139(PC10) 140(PC11) 141(PC12) 144(PD2) 145(PD3) 150(PD6) 151(PD7) 152(PG9) 153(PG10) 154(PG11) 155(PG12) 156(PG13) 160(PG15) 162(PB4) 163(PB5) 167(PB8) 169(PE0) 170(PE1) 173(PI4) 174(PI5) 175(PI6) 176(PI7); DD5 12(~{Y6}); XP3 8

## Layout directives
mark named 3.3V: (no net found under the mark)
mark named 5V: (no net found under the mark)
mark named 0.1mW: (no net found under the mark)
mark named 6.6mW: (no net found under the mark)
mark named 830uW: (no net found under the mark)
mark named 1.1mW: (no net found under the mark)
mark named 2.2mW: (no net found under the mark)
mark named Info: (no net found under the mark)
mark named 0.00011mW: (no net found under the mark)
mark named 3V: (no net found under the mark)
mark named 0.001W: (no net found under the mark)

## Notes on the sheet
- (near XP1) "LCD  ILI9325"
- (near XP3) "LCD ILI9341"
- 82
- "PDR_ON"
- 107
- 1
- 22
- 23
- 24
- 68
- 62
- 93
- 2
- 3
- 25
- 100
- 4
- 5
- 6
- 26
- 83
- "DEBUG"
- 84
- 87
- 108
- 7
- 8
- 69
- 43
- 102
- 10
- 11
- 9
- 15
- 27
- 28
- 103
- 12
- 13
- "SWD"
- 29
- 30
- 31
- 18
- 109
- 14
- 16
- 85
- 86
- 32
- 17
- 70
- 33
- 34
- 20
- 19
- "BOOT0"
- 35
- 36
- 110
- 21
- 37
- 94
- 95
- 71
- "RESET"
- 72
- 111
- 96
- 63
- 97
- 98
- 64
- 76
- 67
- 66
- 77
- 99
- 65
- 92
- 91
- 90
- (near XP2) "BUTTONS"
- 104
- 59
- 60
- 105
- 61
- 38
- 39
- 106
- 40
- 41
- 42
- 44
- 45
- 73
- 47
- 53
- 46
- 48
- 74
- 49
- 50
- 88
- 54
- 51
- 52
- 75
- 78
- 89
- 55
- 101
- 79
- 56
- 57
- 58
- 80
- 81
- Перв. примен.
- Справ. №
- Подп. и дата
- Инв. № дубл.
- Взам. инв. №
- Изм.
- Лист
- № докум.
- Подп.
- Дата
- Лит.
- Масса
- Масштаб
- Пров.
- Разраб.
- Листов
- Инв. № подл.
- Н.контр.
- Утв.
- Копировал:
- Формат А1
- (in symbol 2) Конт.; Цепь
- (in symbol 3) Конт.; Цепь
- (in symbol 4) Конт.; Цепь
- (in symbol 43) Конт.; Цепь
- (in symbol 44) Конт.; Цепь
- (in symbol 57) Цепь; Конт.
- (in symbol 109) DD
- (in symbol 112) STU
- (in symbol 445) Цепь; Конт.; Vbus; D-; D+; GND